# Altium schematic sheet GenPulseBox.SchDoc (part 2 of 2) (continued)
## Library data of the parts (continued)
XP2 = 57: Manufacturer: АО «Карачевский завод Электродеталь»; ManufacturerTU: РЮМК.430420.011ТУ; PartNumber: Вилка СНП346-34ВП22-2-В; Conn35Name: 35; Conn36Name: 36; Conn37Name: 37; Conn38Name: 38; Conn39Name: 39; Conn40Name: 40; Conn01Name: GND; Conn02Name: 3.3V_D; Conn03Name: PAGE_UP; Conn04Name: PROG1; Conn05Name: PROG2; Conn06Name: PROG3; Conn07Name: PROG4; Conn08Name: PROG5; Conn09Name: PROG6; Conn10Name: PAGE_DOWN; Conn11Name: CH1(1)_ON; Conn12Name: CH1(1)_REV; Conn13Name: CH1(2)_ON; Conn14Name: CH1(2)_REV; Conn15Name: CH2(1)_ON; Conn16Name: CH2(1)_REV; Conn17Name: CH2(2)_ON; Conn18Name: CH2(2)_REV; Conn19Name: CALIBR_TP; Conn21Name: LED_PWR_G; Conn22Name: LED_PWR_B; Conn20Name: LED_PWR_R; Conn23Name: LED_CH1(1)_R; Conn24Name: LED_CH1(1)_G; Conn25Name: LED_CH1(1)_B; Conn26Name: LED_CH2(1)_R; Conn27Name: LED_CH2(1)_G; Conn28Name: LED_CH2(1)_B; Conn29Name: LED_CH1(2)_R; Conn30Name: LED_CH1(2)_G; Conn31Name: LED_CH1(2)_B; Conn32Name: LED_CH2(2)_R; Conn33Name: LED_CH2(2)_G; Conn34Name: LED_CH2(2)_B; Alternative2: СНП346-34ВП22-2 РЮМК.430420.019ТУ; Name: СНП346-34ВП22-2-В; Value: 34; Group: Соединители; ViewControl: В, 10%; key: 57; SolderName: SNP346-34VP22-2; Mass: 0,00204; TemperatureRange: от минус 60 до 85; CardKRR: 75; VoltageLimit: 250; CurrentLimit: 1; X_SORT_1: 700; X_SORT_2: 600; Alternative: PLD-34; MilitaryControl: ВП; MountType: РМ; Modify: 19.09.2018; Package: PLD; ComponentLink1Description: СНП346; ComponentLink1URL: \\192.168.0.101\U_Base\PDF\X\СНП346.pdf; HelpURL: \\192.168.0.101\U_Base\PDF\X\СНП346.pdf; DataSheet: #\\192.168.0.101\U_Base\PDF\X\СНП346.pdf#; PowerLimit: 250; X_SORT_3: 1
XP3 = 57: Manufacturer: АО «Карачевский завод Электродеталь»; ManufacturerTU: РЮМК.430420.011ТУ; PartNumber: Вилка СНП346-34ВП22-2-В; Conn35Name: 35; Conn36Name: 36; Conn37Name: 37; Conn38Name: 38; Conn39Name: 39; Conn40Name: 40; Conn01Name: T_CS; Conn02Name: CLK; Conn03Name: PEN; Conn04Name: F_CS; Conn05Name: MISO; Conn06Name: MOSI; Conn07Name: GND; Conn08Name: NC; Conn09Name: VDD; Conn11Name: BL; Conn13Name: DB15; Conn14Name: SDCS; Conn15Name: DB13; Conn16Name: DB14; Conn17Name: DB11; Conn18Name: DB12; Conn19Name: DB9; Conn21Name: DB7; Conn22Name: DB8; Conn20Name: DB10; Conn23Name: DB5; Conn24Name: DB6; Conn25Name: DB3; Conn26Name: DB4; Conn27Name: DB1; Conn28Name: DB2; Conn29Name: RST; Conn30Name: DB0; Conn31Name: WR; Conn32Name: RD; Conn33Name: CS; Conn34Name: RS; Alternative2: СНП346-34ВП22-2 РЮМК.430420.019ТУ; Name: СНП346-34ВП22-2-В; Value: 34; Group: Соединители; ViewControl: В, 10%; key: 57; SolderName: SNP346-34VP22-2; Mass: 0,00204; TemperatureRange: от минус 60 до 85; CardKRR: 75; VoltageLimit: 250; CurrentLimit: 1; X_SORT_1: 700; X_SORT_2: 600; Conn10Name: GND; Conn12Name: VDD; Alternative: PLD-34; MilitaryControl: ВП; MountType: РМ; Modify: 19.09.2018; Package: PLD; ComponentLink1Description: СНП346; ComponentLink1URL: \\192.168.0.101\U_Base\PDF\X\СНП346.pdf; HelpURL: \\192.168.0.101\U_Base\PDF\X\СНП346.pdf; DataSheet: #\\192.168.0.101\U_Base\PDF\X\СНП346.pdf#; PowerLimit: 250; X_SORT_3: 1
XP4 = 43: Manufacturer: АО «Карачевский завод Электродеталь»; ManufacturerTU: РЮМК.430420.011ТУ; PartNumber: Вилка СНП346-6ВП22-2-В; Conn07Name: 7; Conn08Name: 8; Conn09Name: 9; Conn10Name: 10; Conn11Name: 11; Conn12Name: 12; Conn13Name: 13; Conn14Name: 14; Conn15Name: 15; Conn16Name: 16; Conn17Name: 17; Conn18Name: 18; Conn19Name: 19; Conn20Name: 20; Conn21Name: 21; Conn22Name: 22; Conn23Name: 23; Conn24Name: 24; Conn25Name: 25; Conn26Name: 26; Conn27Name: 27; Conn28Name: 28; Conn29Name: 29; Conn30Name: 30; Conn31Name: 31; Conn32Name: 32; Conn33Name: 33; Conn34Name: 34; Conn35Name: 35; Conn36Name: 36; Conn37Name: 37; Conn38Name: 38; Conn39Name: 39; Conn40Name: 40; Conn01Name: +3.3V_A; Conn02Name: GNDA; Conn03Name: LEV_CH1(1); Alternative2: СНП346-6ВП22-2 РЮМК.430420.019ТУ; Name: СНП346-6ВП22-2-В; Value: 6; Group: Соединители; ViewControl: В, 10%; key: 43; SolderName: SNP346-6VP22-2; Mass: 0,00036; TemperatureRange: от минус 60 до 85; CardKRR: 75; VoltageLimit: 250; CurrentLimit: 1; X_SORT_1: 700; X_SORT_2: 600; Conn04Name: LEV_CH1(1); Conn05Name: GNDA; Conn06Name: +3.3V_A; Alternative: PLD-6; MilitaryControl: ВП; MountType: РМ; Modify: 19.09.2018; Package: PLD; ComponentLink1Description: СНП346; ComponentLink1URL: \\192.168.0.101\U_Base\PDF\X\СНП346.pdf; HelpURL: \\192.168.0.101\U_Base\PDF\X\СНП346.pdf; DataSheet: #\\192.168.0.101\U_Base\PDF\X\СНП346.pdf#; PowerLimit: 250; X_SORT_3: 1
XP5 = 43: Manufacturer: АО «Карачевский завод Электродеталь»; ManufacturerTU: РЮМК.430420.011ТУ; PartNumber: Вилка СНП346-6ВП22-2-В; Conn07Name: 7; Conn08Name: 8; Conn09Name: 9; Conn10Name: 10; Conn11Name: 11; Conn12Name: 12; Conn13Name: 13; Conn14Name: 14; Conn15Name: 15; Conn16Name: 16; Conn17Name: 17; Conn18Name: 18; Conn19Name: 19; Conn20Name: 20; Conn21Name: 21; Conn22Name: 22; Conn23Name: 23; Conn24Name: 24; Conn25Name: 25; Conn26Name: 26; Conn27Name: 27; Conn28Name: 28; Conn29Name: 29; Conn30Name: 30; Conn31Name: 31; Conn32Name: 32; Conn33Name: 33; Conn34Name: 34; Conn35Name: 35; Conn36Name: 36; Conn37Name: 37; Conn38Name: 38; Conn39Name: 39; Conn40Name: 40; Conn01Name: +3.3V_A; Conn02Name: GNDA; Conn03Name: LEV_CH2(1); Alternative2: СНП346-6ВП22-2 РЮМК.430420.019ТУ; Name: СНП346-6ВП22-2-В; Value: 6; Group: Соединители; ViewControl: В, 10%; key: 43; SolderName: SNP346-6VP22-2; Mass: 0,00036; TemperatureRange: от минус 60 до 85; CardKRR: 75; VoltageLimit: 250; CurrentLimit: 1; X_SORT_1: 700; X_SORT_2: 600; Conn04Name: LEV_CH2(1); Conn05Name: GNDA; Conn06Name: +3.3V_A; Alternative: PLD-6; MilitaryControl: ВП; MountType: РМ; Modify: 19.09.2018; Package: PLD; ComponentLink1Description: СНП346; ComponentLink1URL: \\192.168.0.101\U_Base\PDF\X\СНП346.pdf; HelpURL: \\192.168.0.101\U_Base\PDF\X\СНП346.pdf; DataSheet: #\\192.168.0.101\U_Base\PDF\X\СНП346.pdf#; PowerLimit: 250; X_SORT_3: 1
XP6 = 43: Manufacturer: АО «Карачевский завод Электродеталь»; ManufacturerTU: РЮМК.430420.011ТУ; PartNumber: Вилка СНП346-6ВП22-2-В; Conn07Name: 7; Conn08Name: 8; Conn09Name: 9; Conn10Name: 10; Conn11Name: 11; Conn12Name: 12; Conn13Name: 13; Conn14Name: 14; Conn15Name: 15; Conn16Name: 16; Conn17Name: 17; Conn18Name: 18; Conn19Name: 19; Conn20Name: 20; Conn21Name: 21; Conn22Name: 22; Conn23Name: 23; Conn24Name: 24; Conn25Name: 25; Conn26Name: 26; Conn27Name: 27; Conn28Name: 28; Conn29Name: 29; Conn30Name: 30; Conn31Name: 31; Conn32Name: 32; Conn33Name: 33; Conn34Name: 34; Conn35Name: 35; Conn36Name: 36; Conn37Name: 37; Conn38Name: 38; Conn39Name: 39; Conn40Name: 40; Conn01Name: +3.3V_A; Conn02Name: GNDA; Conn03Name: LEV_CH1(2); Alternative2: СНП346-6ВП22-2 РЮМК.430420.019ТУ; Name: СНП346-6ВП22-2-В; Value: 6; Group: Соединители; ViewControl: В, 10%; key: 43; SolderName: SNP346-6VP22-2; Mass: 0,00036; TemperatureRange: от минус 60 до 85; CardKRR: 75; VoltageLimit: 250; CurrentLimit: 1; X_SORT_1: 700; X_SORT_2: 600; Conn04Name: LEV_CH1(2); Conn05Name: GNDA; Conn06Name: +3.3V_A; Alternative: PLD-6; MilitaryControl: ВП; MountType: РМ; Modify: 19.09.2018; Package: PLD; ComponentLink1Description: СНП346; ComponentLink1URL: \\192.168.0.101\U_Base\PDF\X\СНП346.pdf; HelpURL: \\192.168.0.101\U_Base\PDF\X\СНП346.pdf; DataSheet: #\\192.168.0.101\U_Base\PDF\X\СНП346.pdf#; PowerLimit: 250; X_SORT_3: 1
XP7 = 43: Manufacturer: АО «Карачевский завод Электродеталь»; ManufacturerTU: РЮМК.430420.011ТУ; PartNumber: Вилка СНП346-6ВП22-2-В; Conn07Name: 7; Conn08Name: 8; Conn09Name: 9; Conn10Name: 10; Conn11Name: 11; Conn12Name: 12; Conn13Name: 13; Conn14Name: 14; Conn15Name: 15; Conn16Name: 16; Conn17Name: 17; Conn18Name: 18; Conn19Name: 19; Conn20Name: 20; Conn21Name: 21; Conn22Name: 22; Conn23Name: 23; Conn24Name: 24; Conn25Name: 25; Conn26Name: 26; Conn27Name: 27; Conn28Name: 28; Conn29Name: 29; Conn30Name: 30; Conn31Name: 31; Conn32Name: 32; Conn33Name: 33; Conn34Name: 34; Conn35Name: 35; Conn36Name: 36; Conn37Name: 37; Conn38Name: 38; Conn39Name: 39; Conn40Name: 40; Conn01Name: +3.3V_A; Conn02Name: GNDA; Conn03Name: LEV_CH2(2); Alternative2: СНП346-6ВП22-2 РЮМК.430420.019ТУ; Name: СНП346-6ВП22-2-В; Value: 6; Group: Соединители; ViewControl: В, 10%; key: 43; SolderName: SNP346-6VP22-2; Mass: 0,00036; TemperatureRange: от минус 60 до 85; CardKRR: 75; VoltageLimit: 250; CurrentLimit: 1; X_SORT_1: 700; X_SORT_2: 600; Conn04Name: LEV_CH2(2); Conn05Name: GNDA; Conn06Name: +3.3V_A; Alternative: PLD-6; MilitaryControl: ВП; MountType: РМ; Modify: 19.09.2018; Package: PLD; ComponentLink1Description: СНП346; ComponentLink1URL: \\192.168.0.101\U_Base\PDF\X\СНП346.pdf; HelpURL: \\192.168.0.101\U_Base\PDF\X\СНП346.pdf; DataSheet: #\\192.168.0.101\U_Base\PDF\X\СНП346.pdf#; PowerLimit: 250; X_SORT_3: 1
XP8 = 43: Manufacturer: АО «Карачевский завод Электродеталь»; ManufacturerTU: РЮМК.430420.011ТУ; PartNumber: Вилка СНП346-6ВП22-2-В; Conn07Name: 7; Conn08Name: 8; Conn09Name: 9; Conn10Name: 10; Conn11Name: 11; Conn12Name: 12; Conn13Name: 13; Conn14Name: 14; Conn15Name: 15; Conn16Name: 16; Conn17Name: 17; Conn18Name: 18; Conn19Name: 19; Conn20Name: 20; Conn21Name: 21; Conn22Name: 22; Conn23Name: 23; Conn24Name: 24; Conn25Name: 25; Conn26Name: 26; Conn27Name: 27; Conn28Name: 28; Conn29Name: 29; Conn30Name: 30; Conn31Name: 31; Conn32Name: 32; Conn33Name: 33; Conn34Name: 34; Conn35Name: 35; Conn36Name: 36; Conn37Name: 37; Conn38Name: 38; Conn39Name: 39; Conn40Name: 40; Conn01Name: +3.3V_A; Conn02Name: GNDA; Conn03Name: LEV_SYNC; Alternative2: СНП346-6ВП22-2 РЮМК.430420.019ТУ; Name: СНП346-6ВП22-2-В; Value: 6; Group: Соединители; ViewControl: В, 10%; key: 43; SolderName: SNP346-6VP22-2; Mass: 0,00036; TemperatureRange: от минус 60 до 85; CardKRR: 75; VoltageLimit: 250; CurrentLimit: 1; X_SORT_1: 700; X_SORT_2: 600; Conn04Name: LEV_SYNC; Conn05Name: GNDA; Conn06Name: +3.3V_A; Alternative: PLD-6; MilitaryControl: ВП; MountType: РМ; Modify: 19.09.2018; Package: PLD; ComponentLink1Description: СНП346; ComponentLink1URL: \\192.168.0.101\U_Base\PDF\X\СНП346.pdf; HelpURL: \\192.168.0.101\U_Base\PDF\X\СНП346.pdf; DataSheet: #\\192.168.0.101\U_Base\PDF\X\СНП346.pdf#; PowerLimit: 250; X_SORT_3: 1
XP9 = 2: PartNumber: Вилка СНП346-2ВП22-1-В; Manufacturer: АО «Карачевский завод Электродеталь»; ManufacturerTU: РЮМК.430420.011ТУ; Conn01Name: PDR_ON; Conn02Name: GND; Conn03Name: 3; Conn04Name: 4; Conn05Name: 5; Conn06Name: 6; Conn07Name: 7; Conn08Name: 8; Conn09Name: 9; Conn10Name: 10; Conn11Name: 11; Conn12Name: 12; Conn13Name: 13; Conn14Name: 14; Conn15Name: 15; Conn16Name: 16; Conn17Name: 17; Conn18Name: 18; Conn19Name: 19; Conn20Name: 20; Conn21Name: 21; Conn22Name: 22; Conn23Name: 23; Conn24Name: 24; Conn25Name: 25; Conn26Name: 26; Conn27Name: 27; Conn28Name: 28; Conn29Name: 29; Conn30Name: 30; Conn31Name: 31; Conn32Name: 32; Conn33Name: 33; Conn34Name: 34; Conn35Name: 35; Conn36Name: 36; Conn37Name: 37; Conn38Name: 38; Conn39Name: 39; Conn40Name: 40; Alternative2: СНП346-2ВП22-1 РЮМК.430420.019ТУ; Name: СНП346-2ВП22-1-В; Value: 2; Group: Соединители; ViewControl: В, 10%; SolderName: SNP346-2VP22-1; X_SORT_1: 700; X_SORT_2: 600; X_SORT_3: 1; Mass: 0,00012; TemperatureRange: от минус 60 до 85; CardKRR: 75; VoltageLimit: 250; Alternative: PLS-2; MilitaryControl: ВП; MountType: РМ; Modify: 19.09.2018; Package: PLS; ComponentLink1Description: СНП346; ComponentLink1URL: \\192.168.0.253\U_Base\PDF\X\СНП346.pdf; HelpURL: \\192.168.0.253\U_Base\PDF\X\СНП346.pdf; DataSheet: #\\192.168.0.253\U_Base\PDF\X\СНП346.pdf#; PowerLimit: 250; CurrentLimit: 1; key: 2
XP10 = 3: PartNumber: Вилка СНП346-3ВП22-1-В; Manufacturer: АО «Карачевский завод Электродеталь»; ManufacturerTU: РЮМК.430420.011ТУ; Conn03Name: GND; Conn02Name: USART1_RX; Conn01Name: USART1_TX; Conn04Name: 4; Conn05Name: 5; Conn06Name: 6; Conn07Name: 7; Conn08Name: 8; Conn09Name: 9; Conn10Name: 10; Conn11Name: 11; Conn12Name: 12; Conn13Name: 13; Conn14Name: 14; Conn15Name: 15; Conn16Name: 16; Conn17Name: 17; Conn18Name: 18; Conn19Name: 19; Conn20Name: 20; Conn21Name: 21; Conn22Name: 22; Conn23Name: 23; Conn24Name: 24; Conn25Name: 25; Conn26Name: 26; Conn27Name: 27; Conn28Name: 28; Conn29Name: 29; Conn30Name: 30; Conn31Name: 31; Conn32Name: 32; Conn33Name: 33; Conn34Name: 34; Conn35Name: 35; Conn36Name: 36; Conn37Name: 37; Conn38Name: 38; Conn39Name: 39; Conn40Name: 40; Alternative2: СНП346-3ВП22-1 РЮМК.430420.019ТУ; Name: СНП346-3ВП22-1-В; Value: 3; Group: Соединители; ViewControl: В, 10%; SolderName: SNP346-3VP22-1; X_SORT_1: 700; X_SORT_2: 600; X_SORT_3: 1; Mass: 0,00018; TemperatureRange: от минус 60 до 85; CardKRR: 75; VoltageLimit: 250; Alternative: PLS-3; MilitaryControl: ВП; MountType: РМ; Modify: 19.09.2018; Package: PLS; ComponentLink1Description: СНП346; ComponentLink1URL: \\192.168.0.253\U_Base\PDF\X\СНП346.pdf; HelpURL: \\192.168.0.253\U_Base\PDF\X\СНП346.pdf; DataSheet: #\\192.168.0.253\U_Base\PDF\X\СНП346.pdf#; PowerLimit: 250; CurrentLimit: 1; key: 3
XP11 = 4: PartNumber: Вилка СНП346-4ВП22-1-В; Manufacturer: АО «Карачевский завод Электродеталь»; ManufacturerTU: РЮМК.430420.011ТУ; Conn05Name: 5; Conn06Name: 6; Conn07Name: 7; Conn08Name: 8; Conn09Name: 9; Conn10Name: 10; Conn11Name: 11; Conn12Name: 12; Conn13Name: 13; Conn14Name: 14; Conn15Name: 15; Conn16Name: 16; Conn17Name: 17; Conn18Name: 18; Conn19Name: 19; Conn20Name: 20; Conn21Name: 21; Conn22Name: 22; Conn23Name: 23; Conn24Name: 24; Conn25Name: 25; Conn26Name: 26; Conn27Name: 27; Conn28Name: 28; Conn29Name: 29; Conn30Name: 30; Conn31Name: 31; Conn32Name: 32; Conn33Name: 33; Conn34Name: 34; Conn35Name: 35; Conn36Name: 36; Conn37Name: 37; Conn38Name: 38; Conn39Name: 39; Conn40Name: 40; Conn02Name: SWCLK; Conn03Name: SDIO; Conn04Name: GND; Conn01Name: 3.3V_D; Alternative2: СНП346-4ВП22-1 РЮМК.430420.019ТУ; Name: СНП346-4ВП22-1-В; Value: 4; Group: Соединители; ViewControl: В, 10%; SolderName: SNP346-4VP22-1; X_SORT_1: 700; X_SORT_2: 600; X_SORT_3: 1; Mass: 0,00024; TemperatureRange: от минус 60 до 85; CardKRR: 75; VoltageLimit: 250; Alternative: PLS-4; MilitaryControl: ВП; MountType: РМ; Modify: 19.09.2018; Package: PLS; ComponentLink1Description: СНП346; ComponentLink1URL: \\192.168.0.253\U_Base\PDF\X\СНП346.pdf; HelpURL: \\192.168.0.253\U_Base\PDF\X\СНП346.pdf; DataSheet: #\\192.168.0.253\U_Base\PDF\X\СНП346.pdf#; PowerLimit: 250; CurrentLimit: 1; key: 4
XP12 = 2: PartNumber: Вилка СНП346-2ВП22-1-В; Manufacturer: АО «Карачевский завод Электродеталь»; ManufacturerTU: РЮМК.430420.011ТУ; Conn01Name: BOOT0; Conn02Name: GND; Conn03Name: 3; Conn04Name: 4; Conn05Name: 5; Conn06Name: 6; Conn07Name: 7; Conn08Name: 8; Conn09Name: 9; Conn10Name: 10; Conn11Name: 11; Conn12Name: 12; Conn13Name: 13; Conn14Name: 14; Conn15Name: 15; Conn16Name: 16; Conn17Name: 17; Conn18Name: 18; Conn19Name: 19; Conn20Name: 20; Conn21Name: 21; Conn22Name: 22; Conn23Name: 23; Conn24Name: 24; Conn25Name: 25; Conn26Name: 26; Conn27Name: 27; Conn28Name: 28; Conn29Name: 29; Conn30Name: 30; Conn31Name: 31; Conn32Name: 32; Conn33Name: 33; Conn34Name: 34; Conn35Name: 35; Conn36Name: 36; Conn37Name: 37; Conn38Name: 38; Conn39Name: 39; Conn40Name: 40; Alternative2: СНП346-2ВП22-1 РЮМК.430420.019ТУ; Name: СНП346-2ВП22-1-В; Value: 2; Group: Соединители; ViewControl: В, 10%; SolderName: SNP346-2VP22-1; X_SORT_1: 700; X_SORT_2: 600; X_SORT_3: 1; Mass: 0,00012; TemperatureRange: от минус 60 до 85; CardKRR: 75; VoltageLimit: 250; Alternative: PLS-2; MilitaryControl: ВП; MountType: РМ; Modify: 19.09.2018; Package: PLS; ComponentLink1Description: СНП346; ComponentLink1URL: \\192.168.0.253\U_Base\PDF\X\СНП346.pdf; HelpURL: \\192.168.0.253\U_Base\PDF\X\СНП346.pdf; DataSheet: #\\192.168.0.253\U_Base\PDF\X\СНП346.pdf#; PowerLimit: 250; CurrentLimit: 1; key: 2
XP13 = 2: PartNumber: Вилка СНП346-2ВП22-1-В; Manufacturer: АО «Карачевский завод Электродеталь»; ManufacturerTU: РЮМК.430420.011ТУ; Conn01Name: NRST; Conn02Name: GND; Conn03Name: 3; Conn04Name: 4; Conn05Name: 5; Conn06Name: 6; Conn07Name: 7; Conn08Name: 8; Conn09Name: 9; Conn10Name: 10; Conn11Name: 11; Conn12Name: 12; Conn13Name: 13; Conn14Name: 14; Conn15Name: 15; Conn16Name: 16; Conn17Name: 17; Conn18Name: 18; Conn19Name: 19; Conn20Name: 20; Conn21Name: 21; Conn22Name: 22; Conn23Name: 23; Conn24Name: 24; Conn25Name: 25; Conn26Name: 26; Conn27Name: 27; Conn28Name: 28; Conn29Name: 29; Conn30Name: 30; Conn31Name: 31; Conn32Name: 32; Conn33Name: 33; Conn34Name: 34; Conn35Name: 35; Conn36Name: 36; Conn37Name: 37; Conn38Name: 38; Conn39Name: 39; Conn40Name: 40; Alternative2: СНП346-2ВП22-1 РЮМК.430420.019ТУ; Name: СНП346-2ВП22-1-В; Value: 2; Group: Соединители; ViewControl: В, 10%; SolderName: SNP346-2VP22-1; X_SORT_1: 700; X_SORT_2: 600; X_SORT_3: 1; Mass: 0,00012; TemperatureRange: от минус 60 до 85; CardKRR: 75; VoltageLimit: 250; Alternative: PLS-2; MilitaryControl: ВП; MountType: РМ; Modify: 19.09.2018; Package: PLS; ComponentLink1Description: СНП346; ComponentLink1URL: \\192.168.0.253\U_Base\PDF\X\СНП346.pdf; HelpURL: \\192.168.0.253\U_Base\PDF\X\СНП346.pdf; DataSheet: #\\192.168.0.253\U_Base\PDF\X\СНП346.pdf#; PowerLimit: 250; CurrentLimit: 1; key: 2
XP14 = 44: Manufacturer: АО «Карачевский завод Электродеталь»; ManufacturerTU: РЮМК.430420.011ТУ; PartNumber: Вилка СНП346-8ВП22-2-В; Conn09Name: 9; Conn10Name: 10; Conn11Name: 11; Conn12Name: 12; Conn13Name: 13; Conn14Name: 14; Conn15Name: 15; Conn16Name: 16; Conn17Name: 17; Conn18Name: 18; Conn19Name: 19; Conn20Name: 20; Conn21Name: 21; Conn22Name: 22; Conn23Name: 23; Conn24Name: 24; Conn25Name: 25; Conn26Name: 26; Conn27Name: 27; Conn28Name: 28; Conn29Name: 29; Conn30Name: 30; Conn31Name: 31; Conn32Name: 32; Conn33Name: 33; Conn34Name: 34; Conn35Name: 35; Conn36Name: 36; Conn37Name: 37; Conn38Name: 38; Conn39Name: 39; Conn40Name: 40; Conn08Name: 3.3V_D; Conn07Name: GND; Conn06Name: SDIO; Conn05Name: SWCLK; Alternative2: СНП346-8ВП22-2 РЮМК.430420.019ТУ; Name: СНП346-8ВП22-2-В; Value: 8; Group: Соединители; ViewControl: В, 10%; key: 44; SolderName: SNP346-8VP22-2; Mass: 0,00048; TemperatureRange: от минус 60 до 85; CardKRR: 75; VoltageLimit: 250; CurrentLimit: 1; X_SORT_1: 700; X_SORT_2: 600; Conn04Name: SWCLK; Conn03Name: SDIO; Conn02Name: GND; Conn01Name: 3.3V_D; Alternative: PLD-8; MilitaryControl: ВП; MountType: РМ; Modify: 19.09.2018; Package: PLD; ComponentLink1Description: СНП346; ComponentLink1URL: \\192.168.0.101\U_Base\PDF\X\СНП346.pdf; HelpURL: \\192.168.0.101\U_Base\PDF\X\СНП346.pdf; DataSheet: #\\192.168.0.101\U_Base\PDF\X\СНП346.pdf#; PowerLimit: 250; X_SORT_3: 1
XP15 = 44: Manufacturer: АО «Карачевский завод Электродеталь»; ManufacturerTU: РЮМК.430420.011ТУ; PartNumber: Вилка СНП346-8ВП22-2-В; Conn09Name: 9; Conn10Name: 10; Conn11Name: 11; Conn12Name: 12; Conn13Name: 13; Conn14Name: 14; Conn15Name: 15; Conn16Name: 16; Conn17Name: 17; Conn18Name: 18; Conn19Name: 19; Conn20Name: 20; Conn21Name: 21; Conn22Name: 22; Conn23Name: 23; Conn24Name: 24; Conn25Name: 25; Conn26Name: 26; Conn27Name: 27; Conn28Name: 28; Conn29Name: 29; Conn30Name: 30; Conn31Name: 31; Conn32Name: 32; Conn33Name: 33; Conn34Name: 34; Conn35Name: 35; Conn36Name: 36; Conn37Name: 37; Conn38Name: 38; Conn39Name: 39; Conn40Name: 40; Conn08Name: RS485_A; Conn07Name: RS485_B; Alternative2: СНП346-8ВП22-2 РЮМК.430420.019ТУ; Name: СНП346-8ВП22-2-В; Value: 8; Group: Соединители; ViewControl: В, 10%; key: 44; SolderName: SNP346-8VP22-2; Mass: 0,00048; TemperatureRange: от минус 60 до 85; CardKRR: 75; VoltageLimit: 250; CurrentLimit: 1; X_SORT_1: 700; X_SORT_2: 600; Conn06Name: RS485_B; Conn05Name: RS485_A; Conn04Name: RS485_A; Conn03Name: RS485_B; Conn02Name: RS485_B; Conn01Name: RS485_A; Alternative: PLD-8; MilitaryControl: ВП; MountType: РМ; Modify: 19.09.2018; Package: PLD; ComponentLink1Description: СНП346; ComponentLink1URL: \\192.168.0.101\U_Base\PDF\X\СНП346.pdf; HelpURL: \\192.168.0.101\U_Base\PDF\X\СНП346.pdf; DataSheet: #\\192.168.0.101\U_Base\PDF\X\СНП346.pdf#; PowerLimit: 250; X_SORT_3: 1
XP16 = 44: Manufacturer: АО «Карачевский завод Электродеталь»; ManufacturerTU: РЮМК.430420.011ТУ; PartNumber: Вилка СНП346-8ВП22-2-В; Conn09Name: 9; Conn10Name: 10; Conn11Name: 11; Conn12Name: 12; Conn13Name: 13; Conn14Name: 14; Conn15Name: 15; Conn16Name: 16; Conn17Name: 17; Conn18Name: 18; Conn19Name: 19; Conn20Name: 20; Conn21Name: 21; Conn22Name: 22; Conn23Name: 23; Conn24Name: 24; Conn25Name: 25; Conn26Name: 26; Conn27Name: 27; Conn28Name: 28; Conn29Name: 29; Conn30Name: 30; Conn31Name: 31; Conn32Name: 32; Conn33Name: 33; Conn34Name: 34; Conn35Name: 35; Conn36Name: 36; Conn37Name: 37; Conn38Name: 38; Conn39Name: 39; Conn40Name: 40; Conn08Name: CH1(1)+; Conn07Name: CH1(1)-; Alternative2: СНП346-8ВП22-2 РЮМК.430420.019ТУ; Name: СНП346-8ВП22-2-В; Value: 8; Group: Соединители; ViewControl: В, 10%; key: 44; SolderName: SNP346-8VP22-2; Mass: 0,00048; TemperatureRange: от минус 60 до 85; CardKRR: 75; VoltageLimit: 250; CurrentLimit: 1; X_SORT_1: 700; X_SORT_2: 600; Conn06Name: CH1(1)-; Conn05Name: CH1(1)+; Conn04Name: CH1(1)+; Conn03Name: CH1(1)-; Conn02Name: CH1(1)-; Conn01Name: CH1(1)+; Alternative: PLD-8; MilitaryControl: ВП; MountType: РМ; Modify: 19.09.2018; Package: PLD; ComponentLink1Description: СНП346; ComponentLink1URL: \\192.168.0.101\U_Base\PDF\X\СНП346.pdf; HelpURL: \\192.168.0.101\U_Base\PDF\X\СНП346.pdf; DataSheet: #\\192.168.0.101\U_Base\PDF\X\СНП346.pdf#; PowerLimit: 250; X_SORT_3: 1
XP17 = 44: Manufacturer: АО «Карачевский завод Электродеталь»; ManufacturerTU: РЮМК.430420.011ТУ; PartNumber: Вилка СНП346-8ВП22-2-В; Conn09Name: 9; Conn10Name: 10; Conn11Name: 11; Conn12Name: 12; Conn13Name: 13; Conn14Name: 14; Conn15Name: 15; Conn16Name: 16; Conn17Name: 17; Conn18Name: 18; Conn19Name: 19; Conn20Name: 20; Conn21Name: 21; Conn22Name: 22; Conn23Name: 23; Conn24Name: 24; Conn25Name: 25; Conn26Name: 26; Conn27Name: 27; Conn28Name: 28; Conn29Name: 29; Conn30Name: 30; Conn31Name: 31; Conn32Name: 32; Conn33Name: 33; Conn34Name: 34; Conn35Name: 35; Conn36Name: 36; Conn37Name: 37; Conn38Name: 38; Conn39Name: 39; Conn40Name: 40; Conn08Name: CH2(1)+; Conn07Name: CH2(1)-; Alternative2: СНП346-8ВП22-2 РЮМК.430420.019ТУ; Name: СНП346-8ВП22-2-В; Value: 8; Group: Соединители; ViewControl: В, 10%; key: 44; SolderName: SNP346-8VP22-2; Mass: 0,00048; TemperatureRange: от минус 60 до 85; CardKRR: 75; VoltageLimit: 250; CurrentLimit: 1; X_SORT_1: 700; X_SORT_2: 600; Conn06Name: CH2(1)-; Conn05Name: CH2(1)+; Conn04Name: CH2(1)+; Conn03Name: CH2(1)-; Conn02Name: CH2(1)-; Conn01Name: CH2(1)+; Alternative: PLD-8; MilitaryControl: ВП; MountType: РМ; Modify: 19.09.2018; Package: PLD; ComponentLink1Description: СНП346; ComponentLink1URL: \\192.168.0.101\U_Base\PDF\X\СНП346.pdf; HelpURL: \\192.168.0.101\U_Base\PDF\X\СНП346.pdf; DataSheet: #\\192.168.0.101\U_Base\PDF\X\СНП346.pdf#; PowerLimit: 250; X_SORT_3: 1
XP18 = 44: Manufacturer: АО «Карачевский завод Электродеталь»; ManufacturerTU: РЮМК.430420.011ТУ; PartNumber: Вилка СНП346-8ВП22-2-В; Conn09Name: 9; Conn10Name: 10; Conn11Name: 11; Conn12Name: 12; Conn13Name: 13; Conn14Name: 14; Conn15Name: 15; Conn16Name: 16; Conn17Name: 17; Conn18Name: 18; Conn19Name: 19; Conn20Name: 20; Conn21Name: 21; Conn22Name: 22; Conn23Name: 23; Conn24Name: 24; Conn25Name: 25; Conn26Name: 26; Conn27Name: 27; Conn28Name: 28; Conn29Name: 29; Conn30Name: 30; Conn31Name: 31; Conn32Name: 32; Conn33Name: 33; Conn34Name: 34; Conn35Name: 35; Conn36Name: 36; Conn37Name: 37; Conn38Name: 38; Conn39Name: 39; Conn40Name: 40; Conn08Name: CH1(2)+; Conn07Name: CH1(2)-; Alternative2: СНП346-8ВП22-2 РЮМК.430420.019ТУ; Name: СНП346-8ВП22-2-В; Value: 8; Group: Соединители; ViewControl: В, 10%; key: 44; SolderName: SNP346-8VP22-2; Mass: 0,00048; TemperatureRange: от минус 60 до 85; CardKRR: 75; VoltageLimit: 250; CurrentLimit: 1; X_SORT_1: 700; X_SORT_2: 600; Conn06Name: CH1(2)-; Conn05Name: CH1(2)+; Conn04Name: CH1(2)+; Conn03Name: CH1(2)-; Conn02Name: CH1(2)-; Conn01Name: CH1(2)+; Alternative: PLD-8; MilitaryControl: ВП; MountType: РМ; Modify: 19.09.2018; Package: PLD; ComponentLink1Description: СНП346; ComponentLink1URL: \\192.168.0.101\U_Base\PDF\X\СНП346.pdf; HelpURL: \\192.168.0.101\U_Base\PDF\X\СНП346.pdf; DataSheet: #\\192.168.0.101\U_Base\PDF\X\СНП346.pdf#; PowerLimit: 250; X_SORT_3: 1
XP19 = 44: Manufacturer: АО «Карачевский завод Электродеталь»; ManufacturerTU: РЮМК.430420.011ТУ; PartNumber: Вилка СНП346-8ВП22-2-В; Conn09Name: 9; Conn10Name: 10; Conn11Name: 11; Conn12Name: 12; Conn13Name: 13; Conn14Name: 14; Conn15Name: 15; Conn16Name: 16; Conn17Name: 17; Conn18Name: 18; Conn19Name: 19; Conn20Name: 20; Conn21Name: 21; Conn22Name: 22; Conn23Name: 23; Conn24Name: 24; Conn25Name: 25; Conn26Name: 26; Conn27Name: 27; Conn28Name: 28; Conn29Name: 29; Conn30Name: 30; Conn31Name: 31; Conn32Name: 32; Conn33Name: 33; Conn34Name: 34; Conn35Name: 35; Conn36Name: 36; Conn37Name: 37; Conn38Name: 38; Conn39Name: 39; Conn40Name: 40; Conn08Name: CH2(2)+; Conn07Name: CH2(2)-; Alternative2: СНП346-8ВП22-2 РЮМК.430420.019ТУ; Name: СНП346-8ВП22-2-В; Value: 8; Group: Соединители; ViewControl: В, 10%; key: 44; SolderName: SNP346-8VP22-2; Mass: 0,00048; TemperatureRange: от минус 60 до 85; CardKRR: 75; VoltageLimit: 250; CurrentLimit: 1; X_SORT_1: 700; X_SORT_2: 600; Conn06Name: CH2(2)-; Conn05Name: CH2(2)+; Conn04Name: CH2(2)+; Conn03Name: CH2(2)-; Conn02Name: CH2(2)-; Conn01Name: CH2(2)+; Alternative: PLD-8; MilitaryControl: ВП; MountType: РМ; Modify: 19.09.2018; Package: PLD; ComponentLink1Description: СНП346; ComponentLink1URL: \\192.168.0.101\U_Base\PDF\X\СНП346.pdf; HelpURL: \\192.168.0.101\U_Base\PDF\X\СНП346.pdf; DataSheet: #\\192.168.0.101\U_Base\PDF\X\СНП346.pdf#; PowerLimit: 250; X_SORT_3: 1
XP20 = 44: Manufacturer: АО «Карачевский завод Электродеталь»; ManufacturerTU: РЮМК.430420.011ТУ; PartNumber: Вилка СНП346-8ВП22-2-В; Conn09Name: 9; Conn10Name: 10; Conn11Name: 11; Conn12Name: 12; Conn13Name: 13; Conn14Name: 14; Conn15Name: 15; Conn16Name: 16; Conn17Name: 17; Conn18Name: 18; Conn19Name: 19; Conn20Name: 20; Conn21Name: 21; Conn22Name: 22; Conn23Name: 23; Conn24Name: 24; Conn25Name: 25; Conn26Name: 26; Conn27Name: 27; Conn28Name: 28; Conn29Name: 29; Conn30Name: 30; Conn31Name: 31; Conn32Name: 32; Conn33Name: 33; Conn34Name: 34; Conn35Name: 35; Conn36Name: 36; Conn37Name: 37; Conn38Name: 38; Conn39Name: 39; Conn40Name: 40; Conn08Name: OUT_SYNC+; Conn07Name: OUT_SYNC-; Alternative2: СНП346-8ВП22-2 РЮМК.430420.019ТУ; Name: СНП346-8ВП22-2-В; Value: 8; Group: Соединители; ViewControl: В, 10%; key: 44; SolderName: SNP346-8VP22-2; Mass: 0,00048; TemperatureRange: от минус 60 до 85; CardKRR: 75; VoltageLimit: 250; CurrentLimit: 1; X_SORT_1: 700; X_SORT_2: 600; Conn06Name: OUT_SYNC-; Conn05Name: OUT_SYNC+; Conn04Name: OUT_SYNC+; Conn03Name: OUT_SYNC-; Conn02Name: OUT_SYNC-; Conn01Name: OUT_SYNC+; Alternative: PLD-8; MilitaryControl: ВП; MountType: РМ; Modify: 19.09.2018; Package: PLD; ComponentLink1Description: СНП346; ComponentLink1URL: \\192.168.0.101\U_Base\PDF\X\СНП346.pdf; HelpURL: \\192.168.0.101\U_Base\PDF\X\СНП346.pdf; DataSheet: #\\192.168.0.101\U_Base\PDF\X\СНП346.pdf#; PowerLimit: 250; X_SORT_3: 1
XP21 = 44: Manufacturer: АО «Карачевский завод Электродеталь»; ManufacturerTU: РЮМК.430420.011ТУ; PartNumber: Вилка СНП346-8ВП22-2-В; Conn09Name: 9; Conn10Name: 10; Conn11Name: 11; Conn12Name: 12; Conn13Name: 13; Conn14Name: 14; Conn15Name: 15; Conn16Name: 16; Conn17Name: 17; Conn18Name: 18; Conn19Name: 19; Conn20Name: 20; Conn21Name: 21; Conn22Name: 22; Conn23Name: 23; Conn24Name: 24; Conn25Name: 25; Conn26Name: 26; Conn27Name: 27; Conn28Name: 28; Conn29Name: 29; Conn30Name: 30; Conn31Name: 31; Conn32Name: 32; Conn33Name: 33; Conn34Name: 34; Conn35Name: 35; Conn36Name: 36; Conn37Name: 37; Conn38Name: 38; Conn39Name: 39; Conn40Name: 40; Conn08Name: IN_SYNC+; Conn07Name: IN_SYNC-; Alternative2: СНП346-8ВП22-2 РЮМК.430420.019ТУ; Name: СНП346-8ВП22-2-В; Value: 8; Group: Соединители; ViewControl: В, 10%; key: 44; SolderName: SNP346-8VP22-2; Mass: 0,00048; TemperatureRange: от минус 60 до 85; CardKRR: 75; VoltageLimit: 250; CurrentLimit: 1; X_SORT_1: 700; X_SORT_2: 600; Conn06Name: IN_SYNC-; Conn05Name: IN_SYNC+; Conn04Name: IN_SYNC+; Conn03Name: IN_SYNC-; Conn02Name: IN_SYNC-; Conn01Name: IN_SYNC+; Alternative: PLD-8; MilitaryControl: ВП; MountType: РМ; Modify: 19.09.2018; Package: PLD; ComponentLink1Description: СНП346; ComponentLink1URL: \\192.168.0.101\U_Base\PDF\X\СНП346.pdf; HelpURL: \\192.168.0.101\U_Base\PDF\X\СНП346.pdf; DataSheet: #\\192.168.0.101\U_Base\PDF\X\СНП346.pdf#; PowerLimit: 250; X_SORT_3: 1
XS1 = 445: Manufacturer: KLS Electronic Co. Ltd; PartNumber: Розетка L-KLS1-151-W; Conn05Name: 5; Conn06Name: 6; Conn07Name: 7; Conn08Name: 8; Conn09Name: 9; Conn10Name: 10; Conn11Name: 11; Conn12Name: 12; Conn13Name: 13; Conn14Name: 14; Conn15Name: 15; Conn16Name: 16; Conn17Name: 17; Conn18Name: 18; Conn19Name: 19; Conn20Name: 20; Conn21Name: 21; Conn22Name: 22; Conn23Name: 23; Conn24Name: 24; Conn25Name: 25; Conn26Name: 26; Conn27Name: 27; Conn28Name: 28; Conn29Name: 29; Conn30Name: 30; Conn31Name: 31; Conn32Name: 32; Conn33Name: 33; Conn34Name: 34; Conn35Name: 35; Conn36Name: 36; Conn37Name: 37; Conn38Name: 38; Conn39Name: 39; Conn40Name: 40; Conn02Name: 2; Conn03Name: 3; Conn04Name: 4; Conn01Name: 1; Name: L-KLS1-151-W; Group: Соединители; ViewControl: В,100%; key: 445; TemperatureRange: от минус 35 до 85; CardKRR: 75; MilitaryControl: отк; MountType: РМ; Modify: 01.09.2022; Package: L-KLS1; ComponentLink1Description: L-KLS1; ComponentLink1URL: \\192.168.0.101\U_Base\PDF\X\L-KLS1-151-W.pdf; HelpURL: \\192.168.0.101\U_Base\PDF\X\L-KLS1-151-W.pdf; DataSheet: #\\192.168.0.101\U_Base\PDF\X\L-KLS1-151-W.pdf#
ZQ1 = 9: Manufacturer: ОАО «Пьезо»; ManufacturerTU: ТУ6321-006-07604008-04; PartNumber: Резонатор кварцевый РК456МДУ-6ДТ-8M-20 пФ-В; Alternative: HC49-SМ 8,000 МГц; Name: РК456МДУ-6ДТ-8M; Group: Резонатор кварцевый; ViewControl: В,100%; Key: 9; SolderName: RK456MDU-6DT; Mark: 8.000; TemperatureRange: от минус 60 до 85; CardKRR: 69; PowerLimit: 0,002; X_SORT_1: 800; X_SORT_3: 1; MilitaryControl: ВП; MountType: РМ; Modify: 14.03.2019; Package: HC49; ComponentLink1URL: \\192.168.0.253\U_Base\PDF\OTHER\РК456МДУ.pdf; HelpURL: \\192.168.0.253\U_Base\PDF\OTHER\РК456МДУ.pdf; DataSheet: #\\192.168.0.253\U_Base\PDF\OTHER\РК456МДУ.pdf#; X_SORT_2: 800